# EasyEDA Pro project MSDRV3.eprj, board PCB3_1
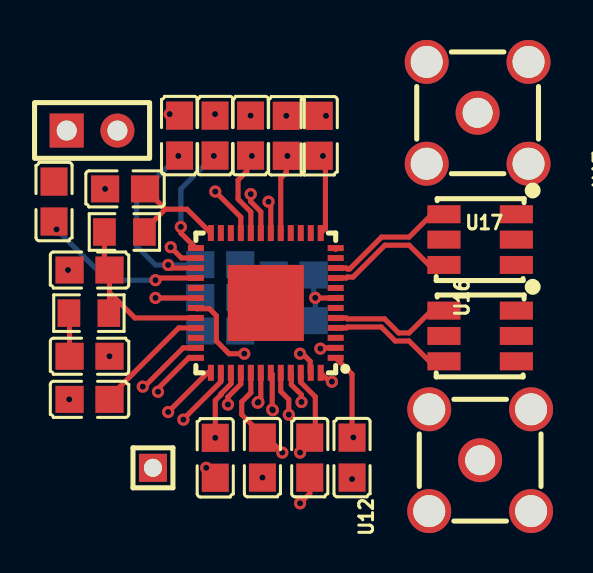
[diagram p10: board, top side]
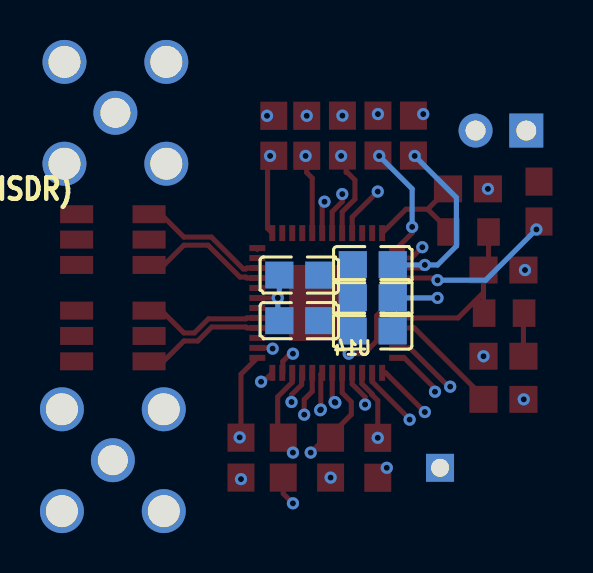
[diagram p11: board, bottom side, seen from below]

No outline. copper layers: Top Layer, GND, Inner1, Inner2, 3.3, Bottom Layer. Coordinates in mm from the lowest, leftmost part position.
Stack: Top Layer 0.035mm 外层铜厚1oz / Dielectric1 0.0994mm 3313 RC57% 4.2mil / GND 0.0152mm 内层铜厚 / Dielectric2 0.55mm 0.55mm H/H不含铜 / Inner1 0.0152mm 内层铜厚 / Dielectric3 0.1088mm 2116 RC54% 4.9mil / Inner2 0.0152mm 内层铜厚 / Dielectric4 0.55mm 0.55mm H/H不含铜 / 3.3 0.0152mm 内层铜厚 / Dielectric5 0.0994mm 3313 RC57% 4.2mil / Bottom Layer 0.035mm 外层铜厚1oz

## Design rules (mm)
net RXQN: RXQ
net RXQP: RXQ
net RXIN: RXI
net RXIP: RXI
net TXQN: TXQ
net TXQP: TXQ
net TXIN: TXI
net TXIP: TXI
net RXP: RX
net RXN: RX
net TXP: TX
net TXN: TX
template: Custom Config
spacing copperThickness1oz (default): track to track 0.102, other pairs 0.152 to 0.3
spacing copperThickness2oz: track to track 0.203, other pairs 0.152 to 0.3
track width copperThickness1oz (default): min 0.127, default 0.254, max 2.54
track width copperThickness2oz: min 0.203, default 0.254, max 2.54
differential pair differentialPair (default): width min 0.127, default 0.254, max 2.54; gap min 0.152, default 0.152
via viaSize (default): diameter min 0.356, default 0.61, max 10; hole min 0.198, default 0.305, max 6.3

## Placement (name value [footprint] x y rotation side)
C18  100nF  [C0805]  1.78 3.43 0 top
C19  100nF  [C0805]  0 13.34 270 top
C20  100pF  [C0805]  3.56 13.97 0 top
C21  2200pF  [C0805]  1.78 5.59 180 top
C22  68pF  [C0805]  1.78 9.91 0 top
CLNA  100pF  [C0805]  14.92 0.51 270 top
CPA  100nF  [C0805]  13.28 16.63 90 top
CPA1  10uF  [C0805]  12 9.65 180 bottom
CPA2  10uF  [C0805]  12 7.37 180 bottom
CPLL  100pF  [C0805]  9.84 16.64 90 top
CRXMX  100pF  [C0805]  12.8 0.51 270 top
CTXMX  100pF  [C0805]  11.63 16.63 90 top
CVCCCP  10nF  [C0805]  8.06 16.64 90 top
CVCO0  100pF  [C0805]  8.32 10.18 0 bottom
CVCO1  100pF  [C0805]  8.32 8.52 0 bottom
CVCO2  100pF  [C0805]  8.33 6.85 0 bottom
CVRXA  100pF  [C0805]  8.07 0.5 270 top
CVRXF  100pF  [C0805]  10.43 0.51 270 top
CVXTAL  100pF  [C0805]  6.28 16.64 90 top
H12  -  [HDR-TH_1P-V-M_XKB_X4611WV-01I-C28D40]  4.95 0 180 top
H21  -  [HDR-TH_2P-P2.54-V-F]  1.91 16.89 0 top
U12  MCX5.08-H5  [SMA-TH_MCX5.08-H5]  21.34 0.38 90 top
U13  MCX5.08-H5  [SMA-TH_MCX5.08-H5]  21.21 17.78 90 top
U14  MAX2831ETM+T  [TQFN-48_L7.0-W7.0-P0.50-TL-EP5.6]  10.6 8.26 180 top
U16  TCM2-43X+  [IND-SMD_6P-L4.1-W3.8-P1.27-TL]  21.34 6.6 270 top
U17  TCM2-43X+  [IND-SMD_6P-L4.1-W3.8-P1.27-TL]  21.34 11.43 270 top
U20  1.2K  [R0805]  1.75 7.75 180 top
U21  750  [R0805]  3.52 11.81 0 top

## Footprints (pads in the part's own frame, mm; a bottom-side part is the same pattern mirrored in y, then rotated)
C0805
  rect 1.41x1.35 smd: 1(-1,0) 2(1,0)
HDR-TH_1P-V-M_XKB_X4611WV-01I-C28D40
  rect 1.4x1.4 hole 0.9: 1(0,0)
HDR-TH_2P-P2.54-V-F
  rect 1.7x1.7 hole 1: 1(-1.27,0)
  round 1.7 hole 1: 2(1.27,0)
IND-SMD_6P-L4.1-W3.8-P1.27-TL
  rect 0.9x1.657 smd: 1(-1.27,1.813) 2(0,1.813) 3(1.27,1.813) 4(1.27,-1.813) 5(0,-1.813) 6(-1.27,-1.813)
R0805
  rect 1.133x1.377 smd: 1(-1,0) 2(1,0)
SMA-TH_MCX5.08-H5
  round 2.2 hole 1.6: 1(-2.55,-2.55) 2(-2.55,2.55) 3(2.55,2.55) 4(2.55,-2.55)
  round 2.2 hole 1.5: 5(0,0)
TQFN-48_L7.0-W7.0-P0.50-TL-EP5.6
  rect 0.8x0.3 smd: 1(-3.5,2.751) 2(-3.5,2.251) 3(-3.5,1.75) 4(-3.5,1.251) 5(-3.5,0.75) 6(-3.5,0.252) 7(-3.5,-0.249) 8(-3.5,-0.75) 9(-3.5,-1.25) 10(-3.5,-1.75) 11(-3.5,-2.249) 12(-3.5,-2.748) 25(3.5,-2.748) 26(3.5,-2.249) 27(3.5,-1.75) 28(3.5,-1.25) 29(3.5,-0.75) 30(3.5,-0.249) 31(3.5,0.252) 32(3.5,0.75) 33(3.5,1.251) 34(3.5,1.75) 35(3.5,2.251) 36(3.5,2.751)
  rect 0.3x0.8 smd: 13(-2.751,-3.5) 14(-2.251,-3.5) 15(-1.75,-3.5) 16(-1.25,-3.5) 17(-0.75,-3.5) 18(-0.251,-3.5) 19(0.249,-3.5) 20(0.75,-3.5) 21(1.25,-3.5) 22(1.75,-3.5) 23(2.251,-3.5) 24(2.751,-3.5) 37(2.751,3.5) 38(2.251,3.5) 39(1.75,3.5) 40(1.25,3.5) 41(0.75,3.5) 42(0.251,3.5) 43(-0.251,3.5) 44(-0.75,3.5) 45(-1.25,3.5) 46(-1.75,3.5) 47(-2.251,3.5) 48(-2.751,3.5)
  rect 3.81x3.81 smd: 49(0,0.001)

## Nets
As in the schematic.

Pads without a net: U14 29 49; U16 5; U17 5

## Via types
v1: diameter 0.61, hole 0.305, Top Layer to Bottom Layer, 47 vias

## Routing (per net, layer and track width the routed paths; a pad name or vN(x,y) marks a point on that pad's centre or on a via; arc(x,y) is an arc through that point)
GND: length 9.1
  Top Layer w0.254: U14.2 13.58,6.01 13.54,5.97 v1(13.33,5.97) ; U14.31 7.14,7.97 7.78,7.97 8.13,7.62 8.13,6.35 8.76,5.72 v1(9.52,5.72) ; v1(12.32,-1.78) 12.8,-1.29 CRXMX.2 ; U14.47 12.83,4.78 12.83,5.33 12.45,5.72 v1(12.32,5.72) ; v1(5.84,11.05) 6.38,10.51 U14.26
  vias: v1(0.7,9.91) v1(0.76,3.43) v1(2.56,13.97) v1(2.78,5.59) v1(5.79,17.72) v1(7.62,0) v1(8.06,17.72) v1(9.84,17.64) v1(10.43,-0.49) v1(11.63,17.63) v1(13.62,17.63) v1(14.92,-0.57)
3.3: length 54.7
  Top Layer w0.254: U14.1 14.92,4.69 14.92,1.59 v1(14.99,1.52) ; v1(13.08,8.51) 13.08,8.51 U14.7 ; v1(9.91,15.62) 9.65,15.37 9.65,14.8 9.6,14.8 9.21,14.41 9.21,13.46 9.85,12.82 U14.20 ; U14.46 12.35,4.28 13.08,3.56 13.08,1.52 v1(12.32,0.76) 12.32,1.03 CRXMX.1 ; U14.27 5.87,10.01 v1(5.71,10.16) ; CVRXF.1 10.68,1.51 v1(11.43,0.76) ; U14.13 13.59,11.99 13.59,15.49 v1(13.46,15.62) ; U14.17 11.35,14.51 11.63,14.79 11.63,15.56 v1(11.68,15.62) ; v1(8.07,1.5) 8.07,3.37 8.37,3.68 8.35,3.7 8.87,4.21 8.87,4.74 U14.39 ; 10.41,1.65 9.4,2.67 9.4,3.3 9.85,3.76 U14.41 ; U14.25 6.35,11.76 v1(6.35,12.06) ; v1(5.08,8.51) 5.08,8.51 U14.30
  Bottom Layer w0.254: v1(6.22,15.62) 4.13,13.53 4.13,11.11 5.08,10.16 v1(5.71,10.16) 7.31,10.16 CVCO0.1 ; CPA2.1 13.08,7.45 v1(13.08,8.51) 13,8.59 CPA1.1 ; v1(6.35,12.06) 6.35,13.97 v1(8,15.62) ; v1(5.08,8.51) 7.31,8.51 CVCO1.1
BYPASS: length 5.9
  Top Layer w0.254: C18.2 2.78,3.54 6.24,7.01 U14.33
CLKBUF: length 2.6
  Top Layer w0.254: U14.21 9.35,12.56 v1(8.07,13.84)
CPOUT: length 5.9
  Top Layer w0.254: 4.56,11.94 4.56,11.84 U21.2 4.52,11.91 4.56,11.94 ; 4.56,11.94 5.57,12.95 ; 5.57,12.95 C20.2 ; 5.57,12.95 6.66,12.95 U14.24
DIN: length 2.2
  Top Layer w0.254: U14.19 10.35,12.82 9.85,13.33 v1(9.85,13.71)
RXHP: length 1.9
  Top Layer w0.254: U14.40 9.35,4.2 8.71,3.55 v1(8.71,3.17)
RXIN: length 3
  Top Layer w0.254: U14.37 7.68,4.76 v1(5.71,2.79)
RXIP: length 3.1
  Top Layer w0.254: U14.38 8.35,4.31 6.48,2.44 v1(6.48,2.41)
RXN: length 6.2
  Top Layer w0.254: U16.6 18.9,7.87 17.78,6.76 17.25,6.76 16.55,7.46 14.68,7.46 14.63,7.51 U14.5
RXP: length 6.2
  Top Layer w0.254: U14.4 14.63,7.01 14.68,7.05 16.38,7.05 17.09,6.35 17.78,6.35 18.8,5.33 U16.4
RXQN: length 3.5
  Top Layer w0.254: v1(4.44,4.06) 4.52,4.06 6.47,6.01 U14.35
RXQP: length 2.7
  Top Layer w0.254: v1(5.21,3.81) 5.21,3.97 6.74,5.51 U14.36
RXTX_MODE: length 0.7
  Top Layer w0.254: U14.48 13.8,4.31 v1(13.91,4.31)
SCLK: length 1.6
  Top Layer w0.254: U14.18 10.85,13.21 v1(10.74,13.33)
SHDN#: length 0.1
  Top Layer w0.254: U14.12 14.1,10.94
TUNE: length 9
  Top Layer w0.254: U14.32 4.05,7.51 2.78,8.78 ; 2.78,8.78 2.78,7.78 U20.1 ; 2.78,8.78 C22.2 2.52,10.16 U21.1
TXIN: length 2.3
  Top Layer w0.254: v1(11.75,2.66) 11.75,3.42 11.35,3.83 U14.44
TXIP: length 1.7
  Top Layer w0.254: v1(12.39,3.3) 12.39,3.65 11.88,4.16 11.88,4.73 U14.45
TXN: length 6.6
  Top Layer w0.254: U17.6 18.92,12.7 17.78,11.56 16.4,11.56 14.8,9.96 14.68,9.96 14.63,10.01 U14.10
TXP: length 6.5
  Top Layer w0.254: U14.9 14.63,9.51 14.68,9.55 14.97,9.55 16.57,11.15 17.78,11.15 18.77,10.16 U17.4
TXQN: length 1.6
  Top Layer w0.254: v1(10.2,3.26) v1(10.23,3.3) 10.35,3.42 U14.42
TXQP: length 1.9
  Top Layer w0.254: U14.43 10.92,4.69 10.92,2.92 ; v1(10.92,2.92) v1(10.96,2.89)
XTAL: length 8.1
  Top Layer w0.254: U14.28 5.19,9.51 v1(5.08,9.4)
  Bottom Layer w0.254: v1(5.08,9.4) 2.67,9.4 v1(0.13,11.94)
$1N20400: length 2.2
  Top Layer w0.254: C21.2 0.78,7.72 U20.2

## Text on the board
Bottom Silkscreen Layer: MIXED SIGNAL DEFINED RADIO (MSDR) / ENGINEER: PACHECK NICHOLAS / VERSION: AFEV0.3
